# EasyEDA Pro project sle_keyboard.eprj, board PCB1 (continued)
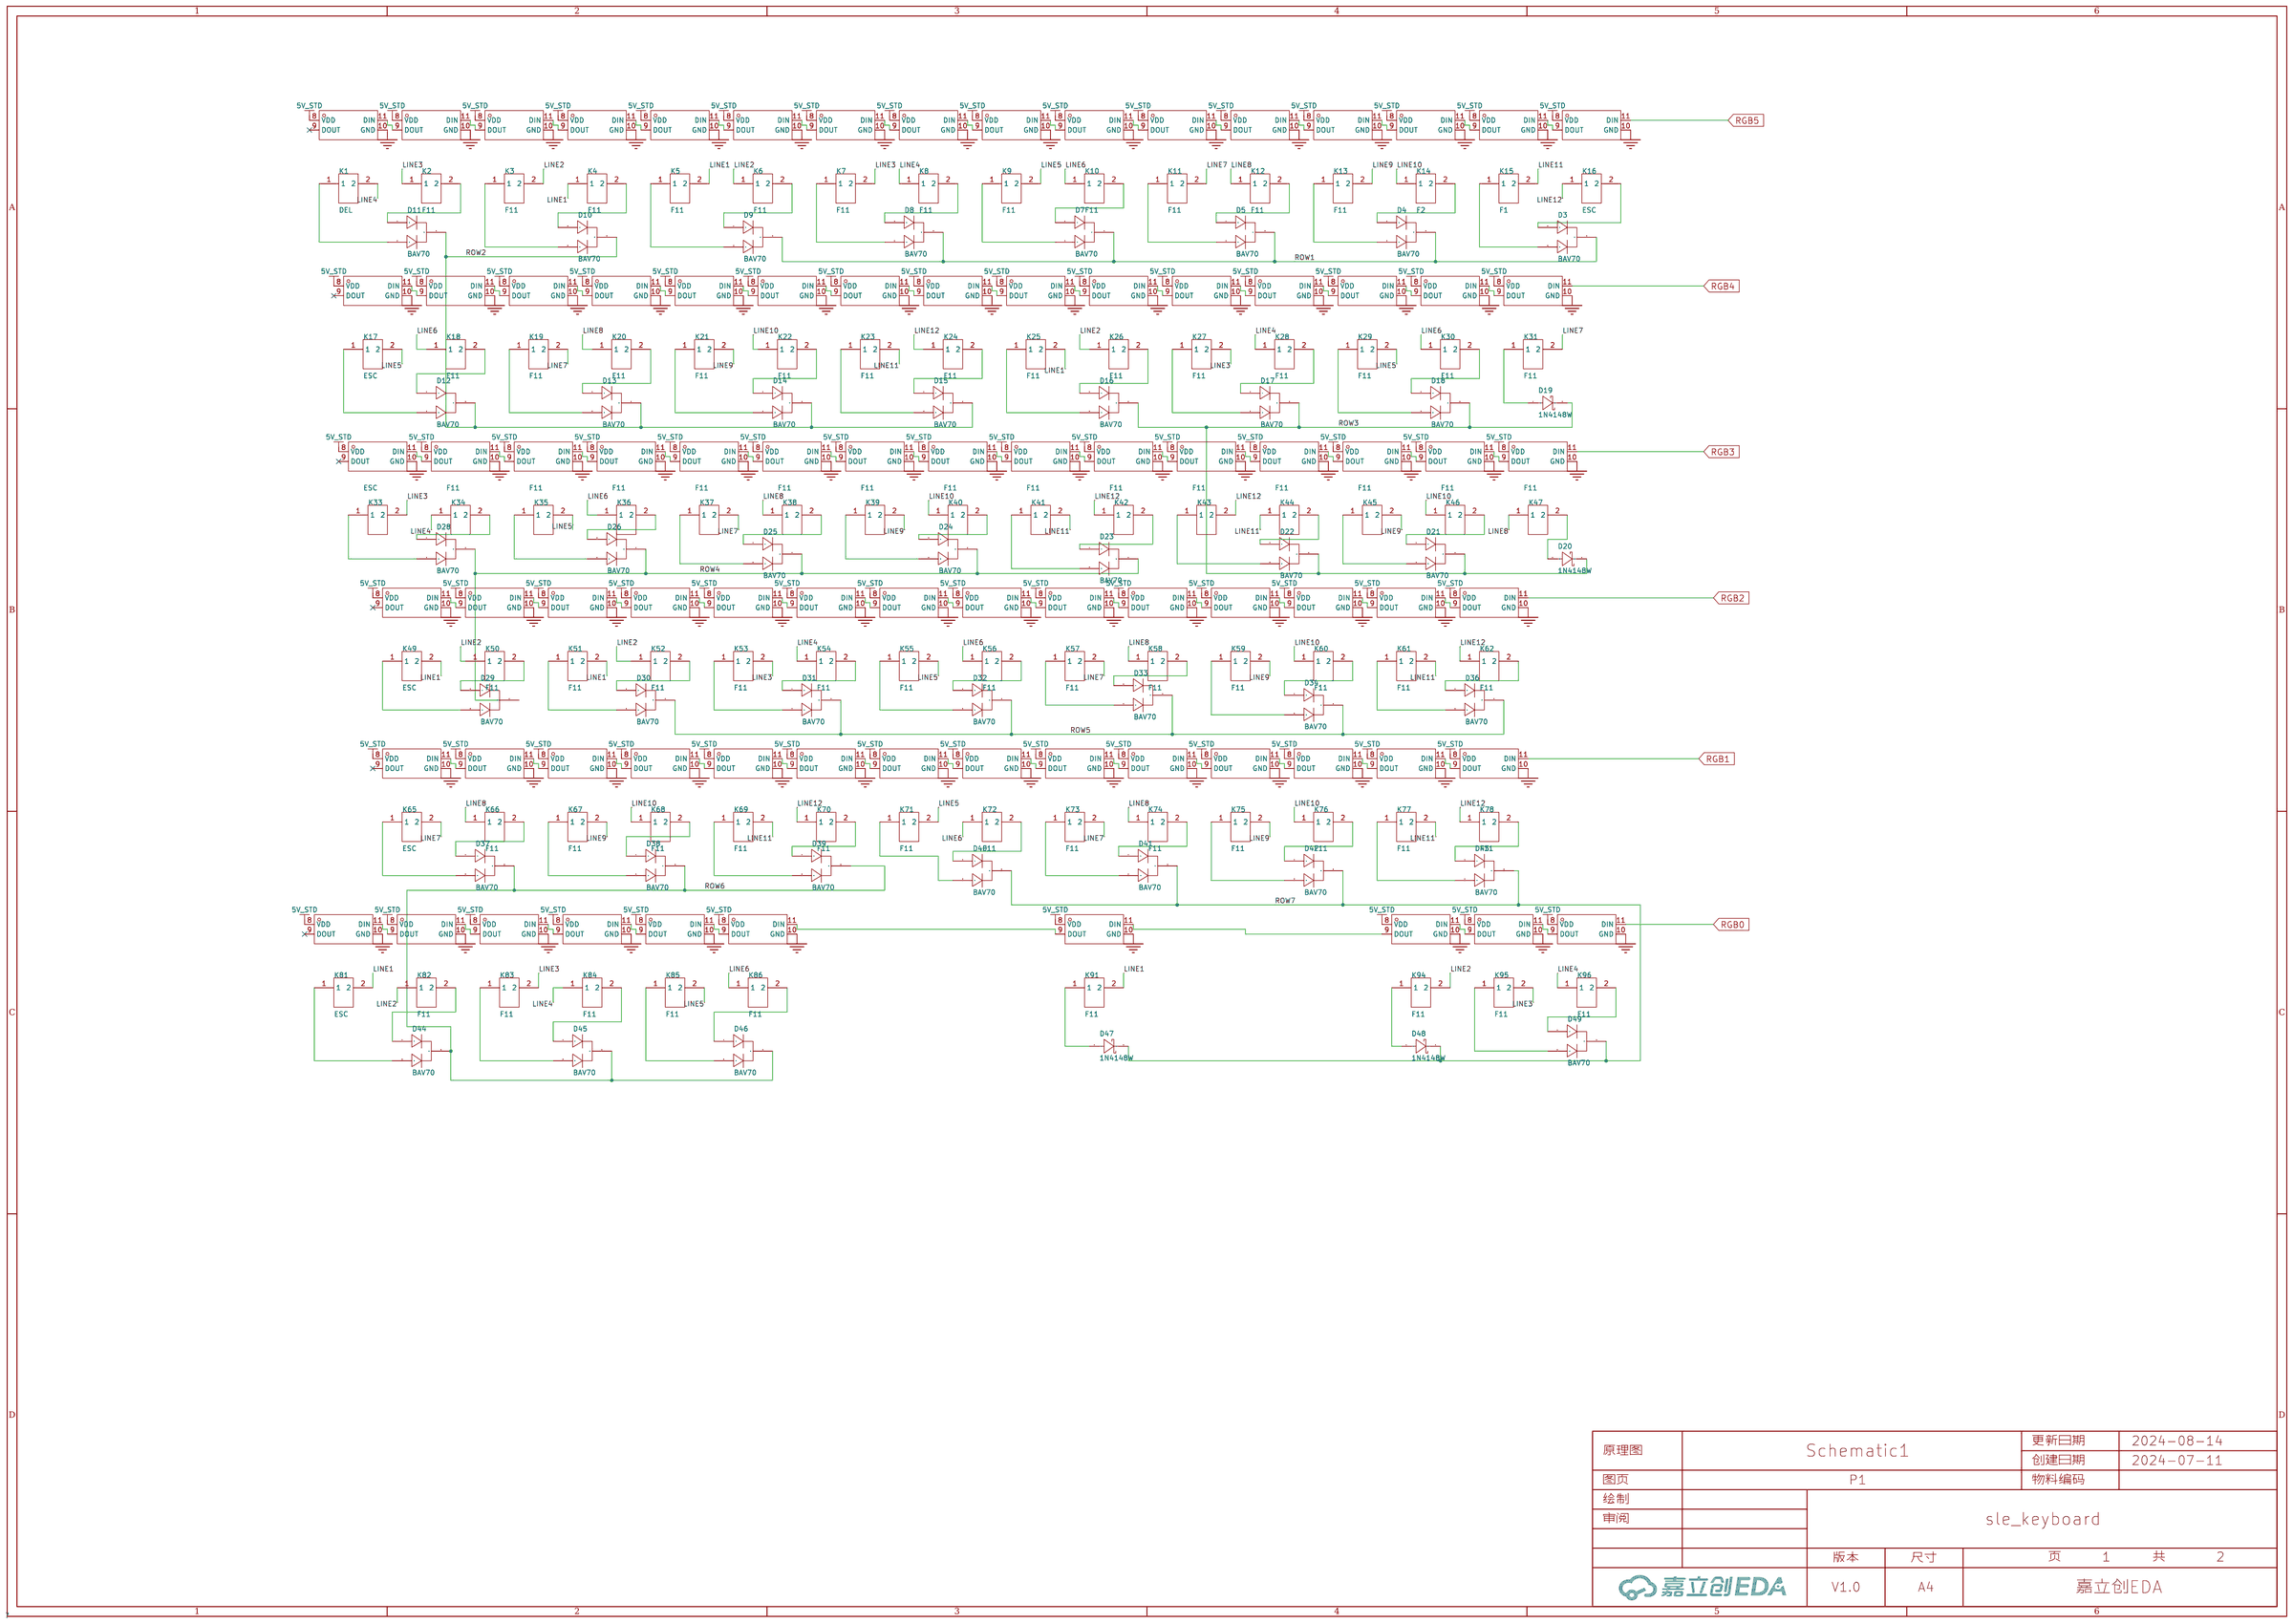
[diagram p0: P1]
## Routing (per net, layer and track width the routed paths; a pad name or vN(x,y) marks a point on that pad's centre or on a via; arc(x,y) is an arc through that point) (continued)
v1(212.6,37.47) v1(212.72,48.13) v1(212.85,54.1) v1(212.98,14.22) v1(213.36,64.77) v1(213.36,54.74) v1(213.49,53.21) v1(213.49,23.37) v1(213.49,18.16) v1(213.61,68.83) v1(213.81,25.1) v1(213.87,37.47) v1(214,70.61) v1(214.5,72.9) v1(214.5,72.01) v1(214.5,70.1) v1(214.63,78.11) v1(214.88,70.61) v1(214.88,63.75) v1(215.01,49.28) v1(215.14,68.83) v1(215.27,72.14) v1(215.39,72.9) v1(215.39,70.1) v1(215.52,12.57) v1(215.65,76.07) v1(215.65,19.69) v1(216.03,42.42) v1(216.03,39.62) v1(216.28,51.82) v1(216.53,77.85) v1(217.17,40.01) v1(217.34,28.72) v1(217.42,27.18) v1(217.93,30.48) v1(218.31,76.2) v1(218.58,35.57) v1(218.69,19.18) v1(219.08,34.93) v1(219.2,39.5) v1(219.2,8.89) v1(219.46,13.59) v1(219.64,35.57) v1(219.58,25.91) v1(220.09,1.78) v1(220.73,19.81) v1(220.98,12.32) v1(221.36,68.58) v1(221.36,67.18) v1(221.6,70.54) v1(221.62,34.29) v1(221.62,3.56) v1(222.63,34.29) v1(223.01,68.58) v1(223.77,111.38) v1(223.77,39.62) v1(223.9,55.37) v1(224.03,34.42) v1(224.03,19.69) v1(224.66,23.11) v1(225.04,18.67) v1(225.43,110.62) v1(225.46,68.58) v1(225.55,12.95) v1(225.68,34.16) v1(225.93,108.33) v1(226.06,8) v1(226.19,31.24) v1(226.31,111.38) v1(226.3,1.56) v1(226.36,28.58) v1(227.71,55.12) v1(227.84,19.69) v1(227.97,22.73) v1(228.09,30.86) v1(228.09,18.67) v1(228.35,108.2) v1(228.6,111.38) v1(228.73,8.89) v1(228.85,110.11) v1(229.11,55.25) v1(229.49,53.72) v1(229.74,93.22) v1(229.74,39.62) v1(230,111.13) v1(230.12,92.58) v1(230.5,55.25) v1(230.63,4.83) v1(230.76,13.21) v1(231.01,108.33) v1(231.65,67.56) v1(231.65,65.79) v1(231.65,55.25) v1(231.65,53.34) v1(232.28,77.72) v1(233.05,72.26) v1(233.05,54.23) v1(233.3,72.9) v1(233.43,77.85) v1(233.8,79.15) v1(233.93,72.14) v1(233.93,55.12) v1(234.06,72.9) v1(234.7,79.12) v1(234.7,77.72) v1(234.7,53.34) v1(234.82,64.52) v1(234.95,42.42) v1(234.95,4.45) v1(235.2,55.12) v1(235.2,41.15) v1(235.33,12.45) v1(235.46,93.22) v1(235.59,76.58) v1(235.71,78.23) v1(236.35,93.22) v1(236.47,79.12) v1(236.47,75.95) v1(236.73,77.72) v1(236.73,76.84) v1(236.98,71.12) v1(237.11,72.77) v1(237.36,72.01) v1(237.49,93.47) v1(237.49,78.36) v1(237.49,75.44) v1(237.49,68.07) v1(237.49,66.42) v1(237.49,64.64) v1(237.74,71.12) v1(237.87,9.91) v1(238,76.96) v1(238,72.77) v1(238.12,77.72) v1(238.25,75.82) v1(238.38,72.01) v1(238.51,34.04) v1(238.63,71.25) v1(238.63,58.93) v1(238.76,72.77) v1(238.89,93.22) v1(239.14,41.91) v1(239.14,35.05) v1(239.27,38.99) v1(239.78,59.06) v1(239.9,59.82) v1(240.03,29.46) v1(240.16,78.11) v1(240.16,77.22) v1(240.54,34.04) v1(240.79,77.72) v1(240.79,68.07) v1(240.92,59.06) v1(241.43,78.36) v1(241.55,55.37) v1(242.32,76.2) v1(242.32,35.05) v1(242.44,55.37) v1(242.38,43.27) v1(242.7,111.38) v1(242.7,21.34) v1(242.7,3.56) v1(243.08,29.08) v1(243.46,55.37) v1(243.46,39.12) v1(243.59,110.62) v1(243.84,33.66) v1(244.09,68.07) v1(244.09,60.96) v1(244.22,69.85) v1(244.35,76.58) v1(244.47,22.61) v1(244.6,78.23) v1(244.6,66.82) v1(244.98,109.86) v1(245.11,68.2) v1(245.11,5.21) v1(245.49,108.08) v1(245.49,61.09) v1(245.62,111.38) v1(245.87,76.2) v1(246.13,109.98) v1(246.13,22.99) v1(246.38,61.98) v1(247.14,93.85) v1(247.14,63.18) v1(247.14,60.62) v1(247.27,55.37) v1(247.65,92.2) v1(247.65,21.46) v1(247.72,95.12) v1(248.03,76.07) v1(248.03,54.62) v1(248.41,93.73) v1(248.41,7.75) v1(248.79,53.85) v1(249.05,29.72) v1(249.17,55.37) v1(249.3,99.57) v1(249.3,39.24) v1(249.68,53.21) v1(249.94,76.07) v1(250.06,68.2) v1(250.06,54.36) v1(250.19,14.86) v1(250.44,55.37) v1(250.7,69.85) v1(250.7,67.44) v1(250.83,65.66) v1(250.95,22.73) v1(250.95,17.02) v1(251.33,54.36) v1(251.33,46.48) v1(251.46,68.2) v1(251.59,53.34) v1(251.71,49.15) v1(251.84,76.07) v1(251.84,64.14) v1(251.84,55.37) v1(251.97,69.85) v1(252.09,17.15) v1(252.09,15.88) v1(252.09,7.37) v1(252.35,42.67) v1(252.48,73.53) v1(252.48,72.39) v1(252.48,38.99) v1(252.48,14.61) v1(252.6,95.76) v1(252.6,53.72) v1(252.73,70.49) v1(252.98,54.74) v1(252.98,48.39) v1(252.98,15.88) v1(253.11,69.85) v1(253.49,14.61) v1(253.49,10.54) v1(253.62,98.55) v1(253.75,76.07) v1(253.75,72.39) v1(253.75,17.02) v1(253.87,73.53) v1(254,64.14) v1(254.38,70.49) v1(254.38,16.26) v1(254.58,66.82) v1(254.65,65.21) v1(254.94,41.3) v1(255.27,73.53) v1(255.4,72.39) v1(255.4,39.12) v1(255.52,93.35) v1(255.65,76.07) v1(256.03,95.5) v1(256.29,100.2) v1(256.41,5.84) v1(257.05,73.53) v1(257.18,72.39) v1(257.3,34.29) v1(257.43,93.22) v1(257.43,35.31) v1(257.68,76.07) v1(257.94,39.12) v1(258.7,76.07) v1(258.83,35.31) v1(258.83,34.29) v1(258.95,12.32) v1(259.08,13.08) v1(259.21,93.22) v1(259.59,9.91) v1(259.84,76.07) v1(259.97,95.76) v1(260.73,35.18) v1(260.73,12.32) v1(260.86,83.44) v1(260.86,33.91) v1(260.98,39.12) v1(261.11,41.53) v1(261.24,76.07) v1(261.24,26.54) v1(261.59,111.77) v1(261.62,2.54) v1(261.75,12.83) v1(261.87,29.21) v1(261.87,21.46) v1(262,82.8) v1(262,35.18) v1(262.13,33.91) v1(262.25,76.07) v1(262.89,110.36) v1(263.14,83.57) v1(263.27,35.18) v1(263.27,33.78) v1(263.4,21.84) v1(263.52,76.45) v1(263.65,87.88) v1(263.91,111.51) v1(264.03,82.68) v1(264.03,28.45) v1(264.17,85.73) v1(264.41,39.12) v1(264.67,110.36) v1(264.67,35.05) v1(264.67,33.91) v1(265.05,20.83) v1(265.56,75.69) v1(266.32,111.63) v1(266.32,55.25) v1(266.45,35.05) v1(266.45,33.91) v1(266.57,75.95) v1(266.83,76.58) v1(267.33,93.47) v1(267.46,1.27) v1(267.72,39.12) v1(267.84,110.62) v1(267.84,53.34) v1(268.1,92.08) v1(268.35,35.05) v1(268.86,34.04) v1(269.37,55.25) v1(269.49,76.2) v1(269.59,97.78) v1(269.88,22.86) v1(270.26,53.47) v1(270.76,90.81) v1(270.76,76.07) v1(270.89,35.18) v1(270.89,30.86) v1(271.27,34.04) v1(271.91,27.94) v1(271.91,21.08) v1(272.16,34.8) v1(272.29,54.86) v1(272.29,23.24) v1(272.41,39.24) v1(272.67,98.93) v1(272.92,72.14) v1(273.3,94.87) v1(273.56,93.6) v1(273.69,73.03) v1(273.72,40) v1(274.45,39.24) v1(274.7,29.72) v1(274.7,16.76) v1(274.83,15.37) v1(275.08,99.06) v1(275.72,101.12) v1(275.72,73.66) v1(275.72,72.52) v1(276.35,59.31) v1(276.48,76.58) v1(276.73,1.27) v1(276.86,73.66) v1(276.86,66.68) v1(277.11,17.02) v1(277.24,37.47) v1(277.37,94.11) v1(278.26,76.71) v1(278.26,71.25) v1(278.26,15.37) v1(278.38,36.7) v1(278.51,62.87) v1(278.64,21.84) v1(279.15,39.62) v1(279.27,72.52) v1(279.27,37.34) v1(279.78,71.25) v1(280.03,76.58) v1(280.29,41.28) v1(280.42,111.76) v1(280.54,66.8) v1(280.73,72.52) v1(280.67,37.21) v1(280.8,89.28) v1(280.92,36.2) v1(281.05,110.49) v1(281.18,16.89) v1(281.3,111.38) v1(281.81,89.28) v1(281.94,15.37) v1(282.19,76.71) v1(282.2,37.21) v1(282.32,111.51) v1(282.83,36.2) v1(283.22,89.25) v1(283.34,59.06) v1(283.59,16.76) v1(284.23,76.71) v1(284.23,37.21) v1(285.24,39.88) v1(285.37,36.2) v1(286.13,89.79) v1(286.13,76.71) v1(286.26,56.01) v1(286.26,35.94) v1(286.26,2.79) v1(286.64,37.34) v1(287.15,90.81) v1(287.63,35.87) v1(287.65,36.83) v1(287.78,74.68) v1(287.91,89.54) v1(288.16,76.71) v1(288.67,90.81) v1(289.69,76.71) v1(289.81,74.68) v1(290.07,90.68) v1(290.58,26.8) v1(290.83,38.86) v1(291.46,76.71) v1(291.72,74.68) v1(292.48,49.91) v1(292.73,76.71) v1(293.12,29.21) v1(293.24,75.06) v1(293.62,53.72) v1(293.88,51.31) v1(294,76.71) v1(294.13,38.74) v1(294.26,112.9) v1(294.26,33.78) v1(295.27,53.72) v1(295.27,22.73) v1(295.53,55.63) v1(295.87,76.71) v1(296.16,49.66) v1(296.29,74.68) v1(296.29,25.27) v1(296.29,7.11) v1(296.8,76.71) v1(297.56,74.3) v1(297.69,73.03) v1(297.81,76.71) v1(297.81,39.62) v1(297.81,32.77) v1(297.94,27.81) v1(298.58,113.03) v1(298.58,13.34) v1(299.21,17.02) v1(299.59,76.71) v1(299.72,71.12) v1(299.72,7.62) v1(299.97,59.31) v1(300.1,11.68) v1(300.23,111.38) v1(300.23,39.75) v1(300.35,32.26) v1(300.35,10.03) v1(300.48,110.36) v1(300.48,55.12) v1(300.61,65.41) v1(301.24,76.2) v1(301.88,111.38) v1(302.89,111.89) v1(303.15,52.83) v1(303.15,49.15) v1(303.28,31.37) v1(303.4,74.42) v1(303.4,64.52) v1(303.53,71.63) v1(303.53,42.67) v1(303.53,26.16) v1(303.66,56.64) v1(303.78,39.75) v1(303.91,35.31) v2(204.85,5.72) v2(205.61,5.72) v2(206.38,5.72) v2(207.14,5.72) v2(207.9,5.72) v2(208.66,5.72) v2(209.42,5.72) v2(210.19,5.72) v2(210.95,5.72) v2(211.71,5.72) v2(212.47,5.72) v2(213.23,5.72) v2(214,5.72) v2(214.76,5.72) v2(215.52,5.72)
